# EasyEDA Pro project ProProject_IMUSensorNodes202312.epro, board 逆时针节点PCB
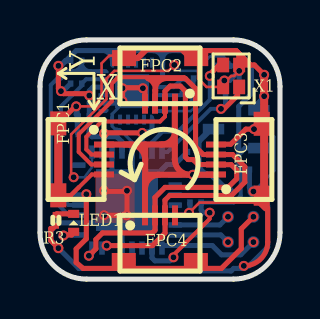
[diagram p2: board, top side]
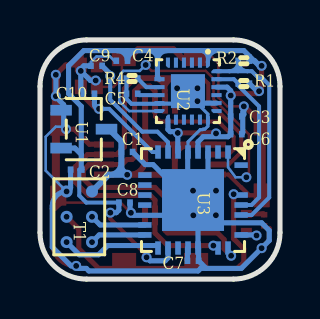
[diagram p3: board, bottom side, seen from below]

Outline 12 x 12 mm; copper layers: Top Layer, Bottom Layer. Coordinates in mm from the lower left corner of the outline.
Outline path: 0,9.67 0,2.33 arc(0.68,0.68) 2.33,0 9.67,0 arc(11.32,0.68) 12,2.33 12,9.67 arc(11.32,11.32) 9.67,12 2.33,12 arc(0.68,11.32) 0,9.67
Stack: Top Layer 0.035mm / Dielectric1 1.51mm FR4 er 4.5 / Bottom Layer 0.035mm

## Design rules (mm)
template: 自定义配置
spacing copperThickness1oz (default): track to track 0.102, other pairs 0.102 to 0.3
spacing copperThickness2oz: track to track 0.203, other pairs 0.152 to 0.3
track width copperThickness1oz (default): min 0.127, default 0.254, max 2.54
track width copperThickness2oz: min 0.203, default 0.254, max 2.54
differential pair differentialPair (default): width min 0.127, default 0.254, max 2.54; gap min 0.152, default 0.152
via viaSize (default): diameter min 0.5, default 0.61, max 10; hole min 0.3, default 0.305, max 6.299
net GND uses copperRegion1

## Placement (name value [footprint] x y rotation side)
C1  1uF  [C0201]  7.65 6.38 180 bottom
C2  1uF  [C0201]  10.19 5.49 0 bottom
C3  100nF  [C0201]  2.19 8.16 180 bottom
C4  100nF  [C0201]  7.91 10.95 0 bottom
C5  100nF  [C0201]  7.4 9.3 180 bottom
C6  100nF  [C0201]  2.19 7.27 0 bottom
C7  100nF  [C0201]  4.35 0.92 0 bottom
C8  100nF  [C0201]  7.78 3.84 180 bottom
C9  9pF  [C0201]  9.17 10.7 180 bottom
C10  9pF  [C0201]  9.56 9.3 0 bottom
FPC1  FPC 0.5MM间距 4P 前插后锁 H1mm 下接  [fpc-0.5mm-4p-h1.0]  3.2 6 270 top
FPC2  FPC 0.5MM间距 4P 前插后锁 H1mm 下接  [fpc-0.5mm-4p-h1.0]  6 8.8 180 top
FPC3  FPC 0.5MM间距 4P 前插后锁 H1mm 下接  [fpc-0.5mm-4p-h1.0#2]  8.8 6 90 top
FPC4  FPC 0.5MM间距 4P 前插后锁 H1mm 下接  [fpc-0.5mm-4p-h1.0]  6 3.2 0 top
LED1  MHT136WDT-C2  [LED0402]  1.68 2.82 90 top
R1  4.7kΩ  [R0201]  1.81 9.81 0 bottom
R2  4.7kΩ  [R0201]  1.81 10.95 0 bottom
R3  1kΩ  [R0201]  0.79 2.95 270 top
R4  10kΩ  [R0201]  7.4 10.06 180 bottom
T1  程序烧录焊点  [TEST]  9.4 4.4 270 bottom
U1  XC6206P332MR  [SOT-23-3_L2.9-W1.6-P1.90-LS2.8-BR]  9.81 7.52 0 bottom
U2  MPU-9250  [QFN-24_L3.0-W3.0-P0.40-BL-EP]  4.6 9.43 0 bottom
U3  ATMEGA328P-MU  [VQFN-32_L5.0-W5.0-P0.50-TL-EP3.1]  4.35 3.97 270 bottom
X1  16MHz  [CRYSTAL-SMD_4P-L1.6-W1.2-BL]  9.56 10.19 90 top

## Footprints (pads in the part's own frame, mm; a bottom-side part is the same pattern mirrored in y, then rotated)
C0201
  rect 0.28x0.318 smd: 1(-0.28,0) 2(0.28,0)
CRYSTAL-SMD_4P-L1.6-W1.2-BL
  rect 0.73x0.6 smd: 1(-0.55,-0.4) 2(0.55,-0.4) 3(0.55,0.4) 4(-0.55,0.4)
fpc-0.5mm-4p-h1.0
  rect 0.3x1 smd: 1(-0.75,0) 2(-0.251,0) 3(0.249,0) 4(0.75,0)
  rect 1.2x0.8 smd: 5(-1.81,-2.286) 6(1.794,-2.286)
fpc-0.5mm-4p-h1.0#2
  rect 0.3x1 smd: 1(-0.75,0) 2(-0.251,0) 3(0.249,0) 4(0.75,0)
  rect 1x0.8 smd: 5(-1.81,-2.286)
  rect 1.2x0.8 smd: 6(1.794,-2.286)
LED0402
  rect 0.4x0.55 smd: 1(-0.45,0) 2(0.45,0)
QFN-24_L3.0-W3.0-P0.40-BL-EP
  custom 0.2x0.506 smd: 1(-1,-1.427) 6(1,-1.427) 13(1,1.427) 18(-1,1.427)
  rect 0.2x0.505 smd: 2(-0.6,-1.427) 3(-0.2,-1.427) 4(0.2,-1.427) 5(0.6,-1.427) 14(0.6,1.427) 15(0.2,1.427) 16(-0.2,1.427) 17(-0.6,1.427)
  rect 0.505x0.2 smd: 8(1.427,-0.6) 9(1.427,-0.2) 10(1.427,0.2) 11(1.427,0.6) 20(-1.427,0.6) 21(-1.427,0.2) 22(-1.427,-0.2) 23(-1.427,-0.6)
  custom 0.506x0.2 smd: 12(1.427,1) 19(-1.427,1) 24(-1.427,-1)
  rect 1.7x1.7 smd: 25(0,0)
R0201
  rect 0.28x0.318 smd: 1(-0.28,0) 2(0.28,0)
SOT-23-3_L2.9-W1.6-P1.90-LS2.8-BR
  rect 1.07x0.532 smd: 1(1.135,-0.95) 2(1.135,0.95) 3(-1.135,0)
TEST
  round 0.6 smd: 1(0,0) 2(1.27,0) 3(2.54,0) 4(0,-1.27) 5(1.27,-1.27) 6(2.54,-1.27)
VQFN-32_L5.0-W5.0-P0.50-TL-EP3.1
  rect 0.665x0.28 smd: 1(-2.408,1.75) 2(-2.408,1.25) 3(-2.408,0.75) 4(-2.408,0.25) 5(-2.408,-0.25) 6(-2.408,-0.75) 7(-2.408,-1.25) 8(-2.408,-1.75) 17(2.408,-1.75) 18(2.408,-1.25) 19(2.408,-0.75) 20(2.408,-0.25) 21(2.408,0.25) 23(2.408,1.25) 24(2.408,1.75)
  rect 0.28x0.665 smd: 10(-1.25,-2.408) 11(-0.75,-2.408) 12(-0.25,-2.408) 13(0.254,-2.413) 15(1.25,-2.408) 16(1.75,-2.408) 25(1.75,2.408) 27(0.75,2.408) 28(0.25,2.408) 29(-0.25,2.408) 32(-1.75,2.408)
  rect 0.003x0.003 smd: 13(0.25,-2.408)
  rect 3.1x3.1 smd: 33(0,0)

## Nets
As in the schematic, except:
GND: C1.2 C2.2 C3.2 C4.2 C5.1 C6.1 C7.1 C8.2 C9.1 C10.2 FPC1.4 FPC1.5 FPC1.6 FPC2.4 FPC2.5 FPC2.6 FPC3.4 FPC3.5 FPC3.6 FPC4.4 R3.2 R4.1 T1.4 U1.1 U2.11 U2.18 U2.20 U2.25 U3.3 U3.5 U3.21 U3.33 X1.2 X1.4
RESET: FPC4.5 FPC4.6 T1.5 U3.29

Pads without a net: U2 2 3 4 5 6 14 15 16 17 19 21; U3 2 10 11 12 13 19 32

## Via types
v1: diameter 0.5, hole 0.3, Top Layer to Bottom Layer, 31 vias
v2: diameter 0.5, hole 0.299, Top Layer to Bottom Layer, 6 vias

## Routing (per net, layer and track width the routed paths; a pad name or vN(x,y) marks a point on that pad's centre or on a via; arc(x,y) is an arc through that point)
3V3: length 49.2
  Top Layer w0.2: v1(6.67,1.09) 6.67,1.21 8.48,3.02 v1(8.48,3.33)
  Top Layer w0.254: v2(5.11,7.33) 3.2,7.34 ; v1(2.46,9.21) 2.37,9.3 1.17,9.3 v1(1.05,9.43) 0.92,9.55 v1(0.92,10.7)
  Bottom Layer w0.2: 3.05,11.46 arc(3.44,11.3) 3.6,10.91 ; 3.6,10.91 arc(3.72,11.34) 4.15,11.46 4.17,11.46 ; 3.6,10.91 U2.1 3.6,11.44 3.59,11.46 1.81,11.46 ; C8.1 9.68,3.84 10.04,4.19 10.04,5.49 9.91,5.62
  Bottom Layer w0.254: U2.22 2.64,9.63 2.46,9.45 2.46,7.27 2.6,7.14 3.84,7.14 4.1,6.88 U3.4 ; U3.18 5.6,1.06 5.75,0.92 6.5,0.92 v1(6.67,1.09) ; 5.64,11.46 arc(5.99,11.32) 6.13,10.98 6.13,10.66 ; 6.13,10.75 6.13,11.03 arc(6.25,11.33) 6.55,11.46 ; 7.65,11.46 1.81,11.46 1.53,11.18 ; 7.65,11.46 7.63,11.43 C4.1 ; 7.65,11.46 8.13,11.46 ; C8.1 8.06,3.46 8.19,3.33 v1(8.48,3.33) ; 6.13,11.08 6.13,10.12 U2.8 ; 6.89,11.46 7.12,11.46 arc(7.48,11.31) C4.1 ; R1.1 1.15,9.43 v1(1.05,9.43) ; 1.3,10.95 1.05,10.7 1.01,10.7 ; 1.3,10.95 1.26,10.95 1.01,10.7 ; 1.3,10.95 R2.1 1.53,11.18 ; 1.3,10.95 1.53,11.18 ; U2.13 5.6,7.51 5.49,7.4 5.17,7.4 v2(5.11,7.33) 5.11,6.39 U3.6 ; 10.82,6.57 10.26,6.57 9.94,6.25 ; 9.94,6.25 9.94,5.52 C2.1 ; 9.94,6.25 9.94,8.67 10.57,9.3 10.57,10.7 9.81,11.46 8.13,11.46 ; C4.1 arc(7.77,11.31) 8.13,11.46 ; 1.01,10.7 v1(0.92,10.7)
  vias: v2(3.2,7.31)
5V: length 28
  Top Layer w0.254: 5.26,6.75 6.75,6.75 6.75,6.75 5.26,6.75 5.26,6.75
  Top Layer w0.3: FPC1.1 5.26,6.75 ; 5.26,6.75 6.74,6.75 6.74,8.8 ; 5.26,6.75 5.26,5.23 8.8,5.23 ; 4.23,6.75 4.5,6.75 arc(5.04,6.53) 5.26,5.99 ; 5.95,5.23 arc(5.46,5.03) 5.25,4.53 5.25,3.94 ; FPC4.1 5.25,5.23 ; 6,6.75 6.09,6.75 arc(6.56,6.95) 6.76,7.42 ; 6.74,6.75 6.74,6 arc(6.96,5.46) 7.51,5.23
  Bottom Layer w0.254: 7.93,6.21 7.93,5.87 arc(8.12,5.42) 8.56,5.23
  Bottom Layer w0.3: 7.65,5.23 7.93,5.51 7.93,6.9 8.55,7.52 ; 7.69,5.23 8.56,5.23 T1.1
  vias: v1(7.64,5.23)
GND: length 104.2
  Top Layer w0.127: 7.91,10.95 7.91,10.06 8.33,9.64 X1.4 9.16,9.79 9.56,10.19 9.71,10.19 v2(9.96,10.44) ; FPC3.5 10.74,3.84 7.97,3.84 v1(7.46,3.33) ; FPC2.6 4.08,11.2 3.46,11.2 3.08,10.82 3.08,9.11 2.64,8.67 v1(1.81,8.67)
  Top Layer w0.178: 3.2,4.47 3.2,5.25
  Top Layer w0.2: 1.94,4.6 2.58,5.25 FPC1.4
  Top Layer w0.22: 1.94,4.6 1.54,4.2 FPC1.6
  Top Layer w0.254: 0.79,2.7 0.64,2.54 0.54,2.54 0.54,1.93 v1(0.92,1.55) ; 3.2,4.4 4.31,4.4 v1(4.35,4.43) 4.35,3.2 3.21,3.2 v1(3.21,3.2) ; 4.09,8.92 4.13,8.95 4.13,9.6 5.25,9.6 5.25,8.8 ; 6.76,3.2 7.33,3.2 arc(7.42,3.24) v1(7.46,3.33) ; 8.81,6.76 9.54,6.76 10.29,7.52 v1(10.7,7.52) ; 11.39,3.54 11.39,1.86 arc(11.04,1.01) v1(10.19,0.66) ; FPC2.5 8.19,11.46 9.81,11.46 9.94,11.33 ; v1(11.21,10.25) 10.72,10.74 10.53,10.74 ; 9.94,11.33 9.94,10.76 X1.2 10.53,10.74 ; 9.94,11.33 10.53,10.74 ; FPC1.5 1.77,8.67 v1(1.81,8.67)
  Top Layer w0.3: FPC2.6 4.88,11.08 5.33,11.53 7.09,11.53 7.5,11.12 7.8,11.12
  Top Layer w0.4: 11.31,3.59 11.09,3.81 FPC3.5 11.21,4.31 11.21,8.03 ; v1(11.21,10.25) 11.21,8.03 ; 11.21,8.03 v1(10.7,7.52) ; FPC1.5 FPC1.6
  Bottom Layer w0.127: 10.82,7.64 11.22,7.64 11.72,7.14 11.72,5.44 v2(10.67,4.4) ; C4.2 8.29,10.95 8.5,11.17 9.18,11.17 9.45,10.89 C9.1
  Bottom Layer w0.152: 4,8.8 4,8.67 3.6,8.27 U2.18 3.6,7.67 3.75,7.52 3.84,7.52 3.87,7.5 3.99,7.5 4.6,6.89 U3.5
  Bottom Layer w0.2: FPC2.4 6,8.8 arc(6.02,8.81) 6.03,8.83 6.07,8.79 7.43,8.79 7.68,9.04 C5.1 R4.1
  Bottom Layer w0.254: 1.86,8.39 1.86,7.34 1.94,7.27 ; 3.69,0.54 1.94,0.54 v1(0.92,1.55) 0.54,1.93 0.54,2.44 0.92,2.82 3.21,2.82 U3.33 ; 3.69,0.54 3.97,0.54 4.09,0.41 9.56,0.41 9.68,0.54 10.06,0.54 v1(10.19,0.66) 10.44,0.66 11.39,1.61 11.39,3.68 arc(11.18,4.19) v2(10.67,4.4) arc(10.53,4.45) 10.47,4.6 C2.2 ; 3.69,0.54 C7.1 4.07,1.53 U3.21 4.1,2.98 ; 3.18,8.83 4.03,8.83 v1(4.13,8.93) ; U3.3 3.6,4.54 ; 4.62,6.41 4.62,4.99 4.48,4.86 ; 5.77,5.17 6.35,5.74 6.74,5.74 C1.2 ; 5.47,3.2 7.33,3.2 v1(7.46,3.33) arc(7.49,3.34) 7.5,3.37 C8.2 ; 9.09,9.96 9.48,9.96 v2(9.96,10.44) ; v2(9.96,10.44) 9.96,10.55 9.81,10.7 9.58,10.7 ; v2(9.96,10.44) 9.96,9.55 9.84,9.43 ; v1(10.7,7.52) 10.82,7.64 10.82,8.75 11.21,9.14 ; v1(11.21,10.25) v1(11.21,9.17) ; v1(1.81,8.67) 1.81,8.26 C3.2
  vias: v1(3.2,4.43) v1(4.13,9.57) v1(4.33,3.2) v1(5.15,9.57) v2(9.22,9.96)
IMU_INT: length 16.4
  Top Layer w0.127: v2(1.68,5.11) 1.56,5.24 1.56,7.26 3.32,9.03 3.32,10.05 3.71,10.44 6.42,10.44 v1(6.72,10.74)
  Bottom Layer w0.127: v2(1.68,5.11) 2.22,5.11 2.6,5.61 U3.1 ; v1(6.72,10.74) 7.01,10.44 7.83,10.44 7.98,10.29 7.98,10.11 8.03,10.06 8.03,8.92 7.54,8.43 U2.12
LED1: length 1
  Top Layer w0.254: 1.33,2.22 1.58,2.22 1.68,2.31
  Bottom Layer w0.254: 1.3,2.19 1.33,2.22 U3.25
  vias: v1(1.17,2.19)
MISO: length 2.8
  Bottom Layer w0.254: U3.16 9.04,2.22 v1(9.4,1.86)
MOSI: length 2.8
  Bottom Layer w0.254: U3.15 8.99,2.72 v1(9.4,3.13)
RESET: length 14.2
  Top Layer w0.254: 2.32,4.22 2.32,2.02 1.81,1.52 1.81,0.83 2.15,0.54 9.07,0.54 10.06,1.53 10.06,2.52 v1(10.67,3.13)
  vias: v1(2.32,4.26)
SCK: length 5
  Bottom Layer w0.254: 6.1,1.69 8.61,1.69 9.08,1.22 10.04,1.22 v1(10.67,1.86)
SCL: length 8.4
  Bottom Layer w0.2: U2.23 2.31,10.03 R1.2 2.09,9.71 1.05,8.67 1.05,4.09 1.42,3.72 U3.28
SDA: length 12.3
  Bottom Layer w0.2: 2.09,10.87 2.09,10.45 2.11,10.43 ; 2.09,10.87 2.09,10.89 ; 2.09,10.87 arc(2.22,10.56) 2.53,10.43 ; 2.11,10.43 2.53,10.43 ; 2.11,10.43 1.63,10.43 ; U3.27 1.42,3.22 0.54,4.09 0.54,9.73 0.87,10.06 1.05,10.06 1.41,10.43 1.63,10.43 ; 2.09,10.89 R2.2 ; 2.09,10.89 arc(1.95,10.56) 1.63,10.43 ; 2.53,10.43 U2.24
SOFTSCL: length 31.9
  Top Layer w0.2: 7.27,10.06 7.21,10.13 3.91,10.13 3.59,9.81 3.59,8.92 1.94,7.27 1.94,6.38 2.57,5.75 FPC1.3
  Top Layer w0.254: v1(3.33,1.68) 5.62,1.68 6.25,2.31 6.25,3.19 FPC4.3 6.25,3.96 6.48,4.19 9.57,4.19 10.24,4.86 10.24,5.64 9.63,6.25 FPC3.3 8.16,6.25 7.78,6.63 7.78,9.55 7.27,10.06 6.25,10.06 ; 5.4,10.06 arc(5.73,9.85) 5.75,9.47 FPC2.3 ; 5.4,10.06 arc(5.74,9.71) 5.75,9.22 5.75,9.03 5.75,9.48 arc(5.92,9.89) 6.33,10.06 5.4,10.06
SOFTSDA: length 25.3
  Top Layer w0.2: FPC2.2 6.25,8.15 6,7.9 3.08,7.9 2.32,7.14 2.32,6.51 2.57,6.25 FPC1.2
  Top Layer w0.254: v1(2.44,1.17) 2.79,1.52 2.79,1.99 3.12,2.31 5.62,2.31 5.75,2.45 5.75,3.19 5.76,3.2 ; FPC4.2 5.75,4.1 6.25,4.6 9.4,4.6 9.83,5.03 9.83,5.47 9.56,5.74 8.8,5.74 ; FPC2.2 6.25,9.43 6.51,9.68 7.02,9.68 7.27,9.43 7.27,6.12 7.4,6 7.65,6 7.9,5.75 FPC3.2
XTAL1: length 7.2
  Top Layer w0.254: 8.41,10.19 8.92,10.7 9.27,10.7
  Bottom Layer w0.2: U3.7 5.6,6.87 6.13,7.4 6.89,7.4 8.49,9 v1(8.49,10.19)
  Bottom Layer w0.254: 8.54,10.19 8.54,10.34 C9.2
XTAL2: length 6.3
  Top Layer w0.254: v1(9.05,8.54) 9.2,8.54 9.88,9.22 9.88,9.56 X1.1
  Bottom Layer w0.2: v1(9.05,8.54) 8.54,8.54 6.38,6.37 U3.8
  Bottom Layer w0.254: C10.1 9.28,8.77 arc(9.21,8.6) v1(9.05,8.54)
$1N1698: length 1.3
  Bottom Layer w0.2: U2.9 6.68,9.63 R4.2
$1N1725: length 1.1
  Bottom Layer w0.2: C5.2 7.04,9.23 U2.10
$1N1083: length 0.9
  Top Layer w0.254: R3.1 0.84,3.27 LED1.2
$1N1108: length 0.7
  Bottom Layer w0.254: U3.20 4.63,1.53 C7.2

## Copper pours and planes (outline as drawn; the poured copper is in the pictures)
5V on Top Layer: 5.13,6.88 6.88,6.88 6.88,5.09 5.13,5.09
GND on Top Layer: 2.75,5.29 4.74,5.29 4.74,2.82 2.75,2.82
GND on Top Layer: -0.1,12.09 12.1,12.09 12.1,-0.1 -0.1,-0.1
GND on Bottom Layer: -0.1,12.09 12.1,12.09 12.1,-0.1 -0.1,-0.1

## Text on the board
Top Silkscreen Layer: X | Y
